# EasyEDA Pro project Archive.eprj, schematic Schematic1
Board Name: CPU; Create Date: 2026-04-07; Page Name: P1; Project Name: Jarvis; Schematic Name: Schematic1; Update Date: 2026-04-08; Company: EasyEDA.com; Page Size: A4; Version: V1.0
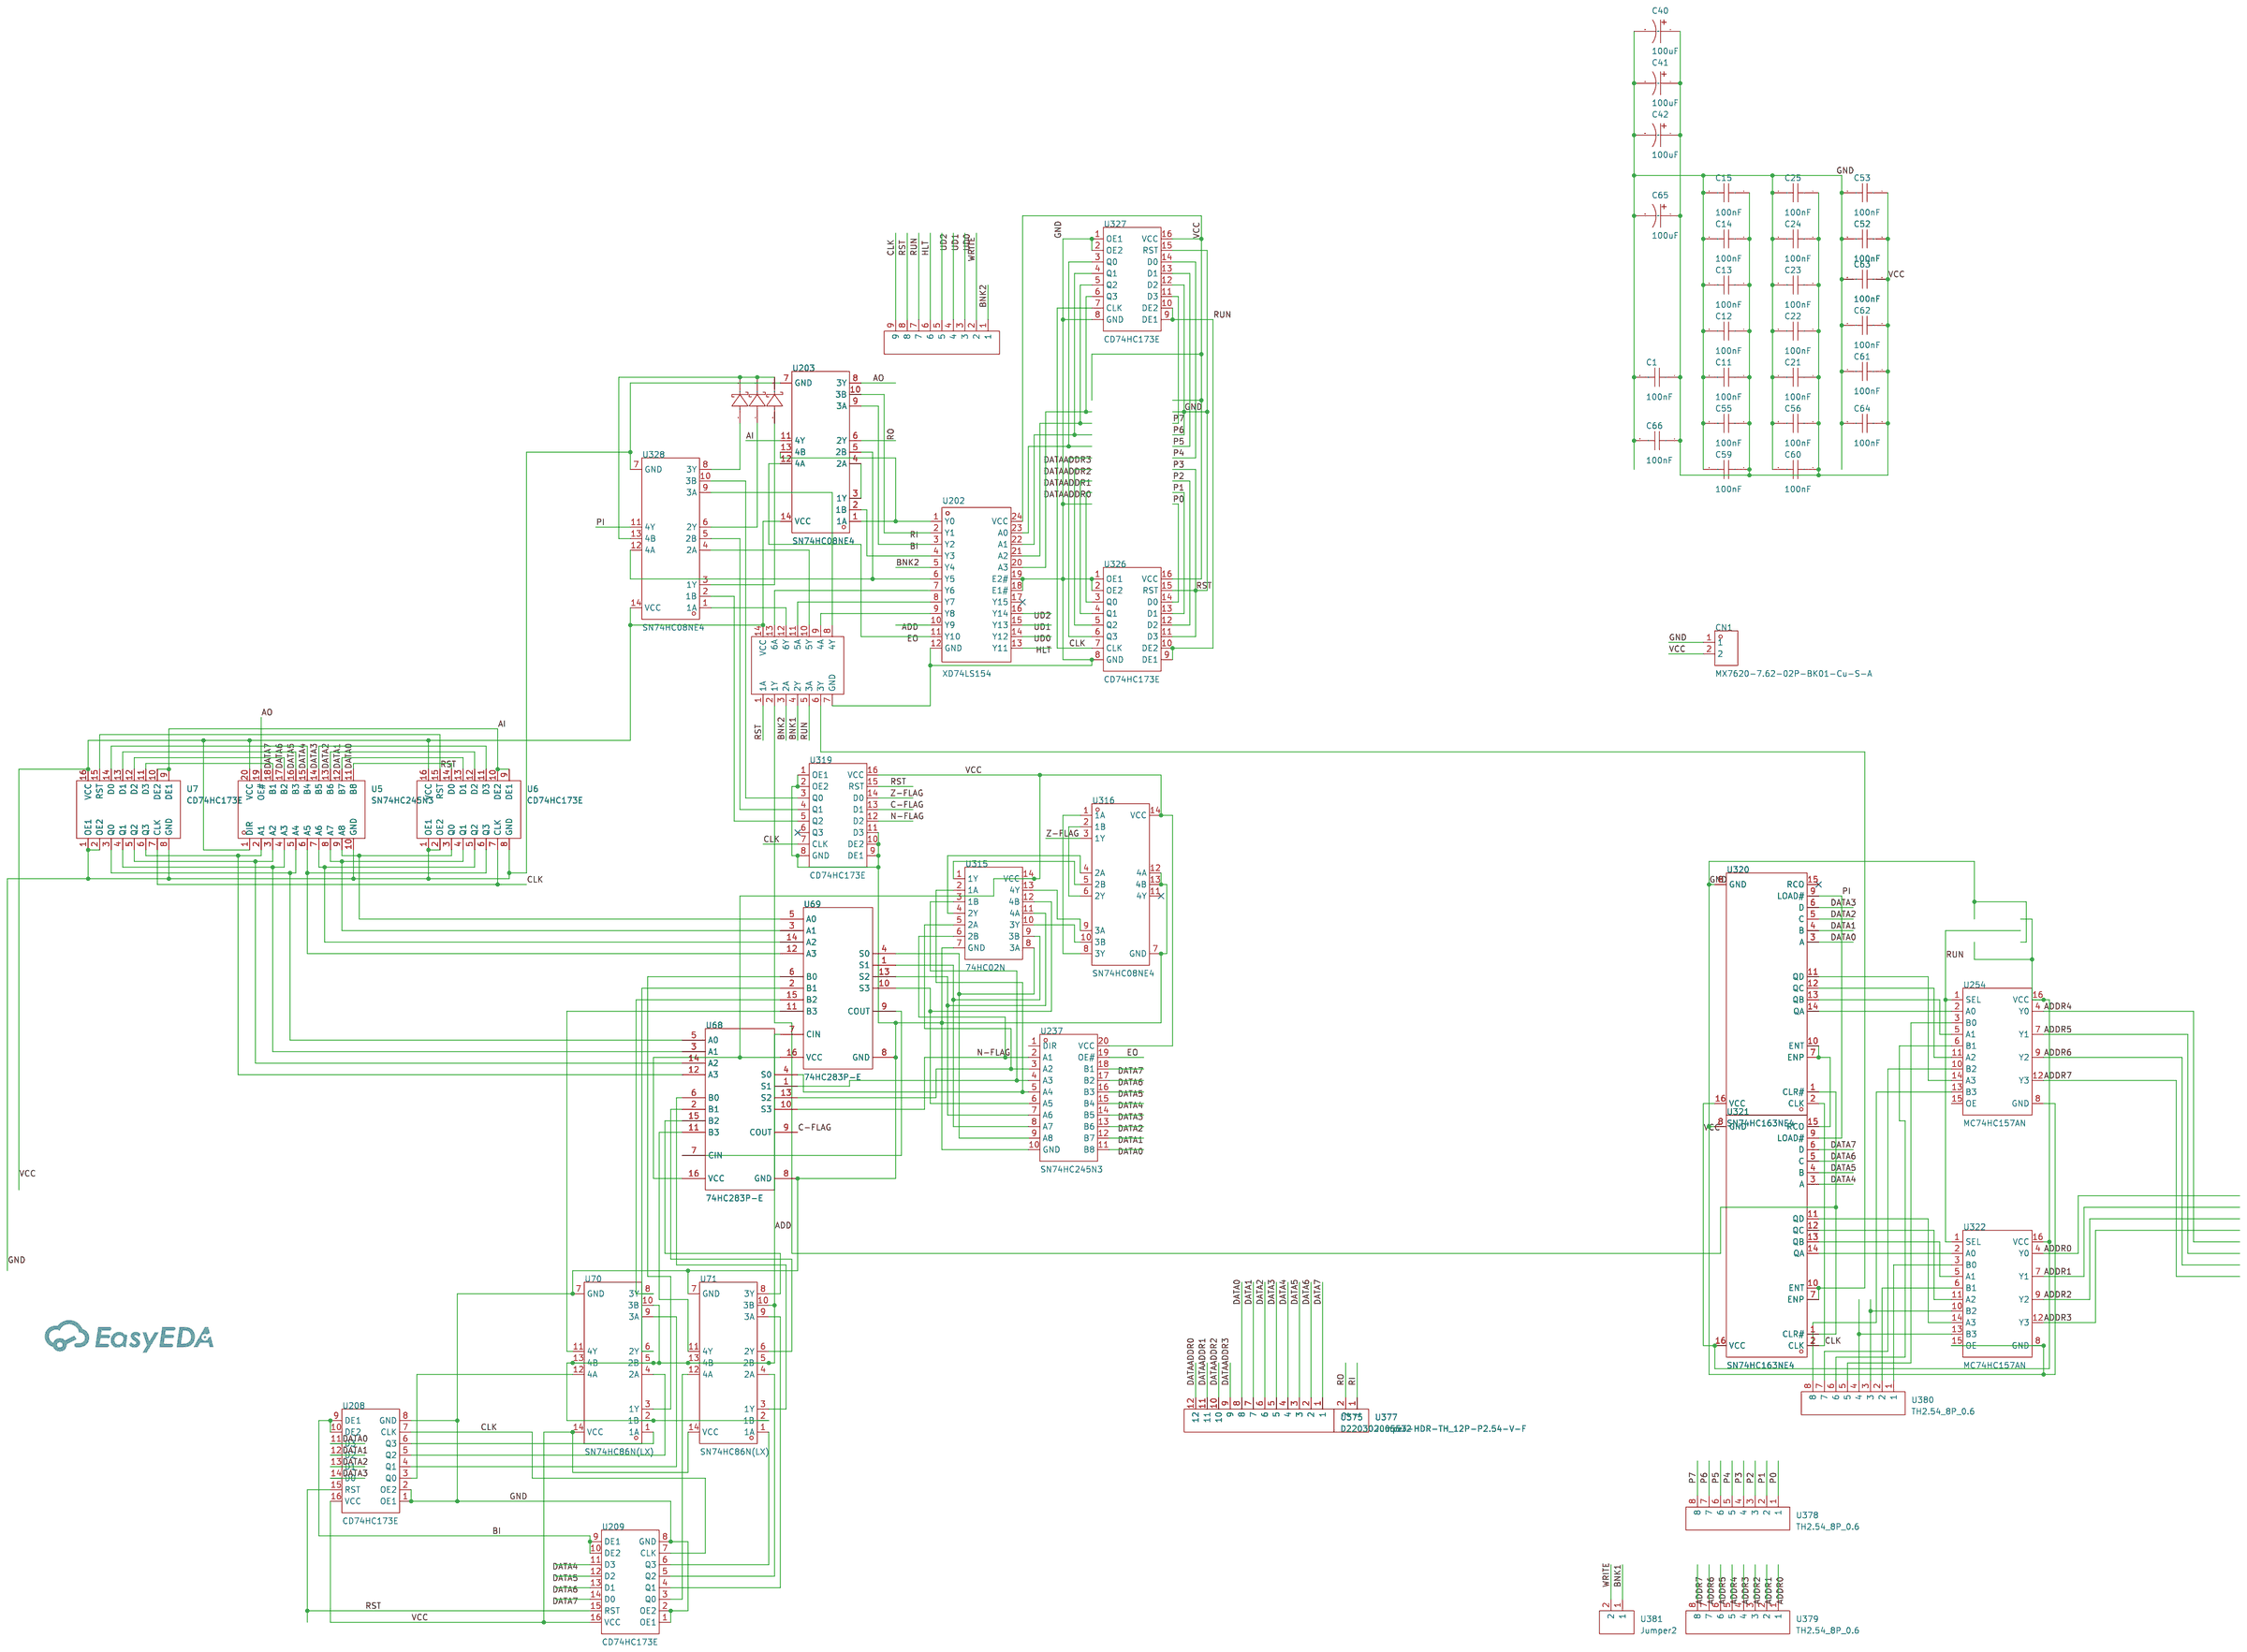
[diagram p1: schematic sheet]

## Parts
C1  100nF  [CAP-TH_L5.0-W2.5-P5.00-D1.0]
C11  100nF  [CAP-TH_L5.0-W2.5-P5.00-D1.0]
C12  100nF  [CAP-TH_L5.0-W2.5-P5.00-D1.0]
C13  100nF  [CAP-TH_L5.0-W2.5-P5.00-D1.0]
C14  100nF  [CAP-TH_L5.0-W2.5-P5.00-D1.0]
C15  100nF  [CAP-TH_L5.0-W2.5-P5.00-D1.0]
C21  100nF  [CAP-TH_L5.0-W2.5-P5.00-D1.0]
C22  100nF  [CAP-TH_L5.0-W2.5-P5.00-D1.0]
C23  100nF  [CAP-TH_L5.0-W2.5-P5.00-D1.0]
C24  100nF  [CAP-TH_L5.0-W2.5-P5.00-D1.0]
C25  100nF  [CAP-TH_L5.0-W2.5-P5.00-D1.0]
C40  100uF  [CAP-TH_BD6.3-P2.50-D1.0-FD]
C41  100uF  [CAP-TH_BD6.3-P2.50-D1.0-FD]
C42  100uF  [CAP-TH_BD6.3-P2.50-D1.0-FD]
C52  100nF  [CAP-TH_L5.0-W2.5-P5.00-D1.0]
C53  100nF  [CAP-TH_L5.0-W2.5-P5.00-D1.0]
C55  100nF  [CAP-TH_L5.0-W2.5-P5.00-D1.0]
C56  100nF  [CAP-TH_L5.0-W2.5-P5.00-D1.0]
C59  100nF  [CAP-TH_L5.0-W2.5-P5.00-D1.0]
C60  100nF  [CAP-TH_L5.0-W2.5-P5.00-D1.0]
C61  100nF  [CAP-TH_L5.0-W2.5-P5.00-D1.0]
C62  100nF  [CAP-TH_L5.0-W2.5-P5.00-D1.0]
C63  100nF  [CAP-TH_L5.0-W2.5-P5.00-D1.0]
C64  100nF  [CAP-TH_L5.0-W2.5-P5.00-D1.0]
C65  100uF  [CAP-TH_BD6.3-P2.50-D1.0-FD]
C66  100nF  [CAP-TH_L5.0-W2.5-P5.00-D1.0]
CN1  MX7620-7.62-02P-BK01-Cu-S-A  [CONN-TH_2P-P7.62_MX7620-7.62-02P-BK01-CU-S-A]
U5  SN74HC245N3  [PDIP-20_L25.9-W6.6-P2.54-LS7.9-BL]
U6  CD74HC173E  [PDIP-16_L19.2-W6.6-P2.54-LS7.6-BL]
U7  CD74HC173E  [PDIP-16_L19.2-W6.6-P2.54-LS7.6-BL]
U68  74HC283P-E  [PDIP-16_L19.3-W6.4-P2.54-LS7.94-BL]
U69  74HC283P-E  [PDIP-16_L19.3-W6.4-P2.54-LS7.94-BL]
U70  SN74HC86N(LX)  [PDIP-14_L19.3-W6.5-P2.54-LS7.6-BL]
U71  SN74HC86N(LX)  [PDIP-14_L19.3-W6.5-P2.54-LS7.6-BL]
U202  XD74LS154  [DIP-24_L31.0-W13.5-P2.54-LS15.2-BL]
U203  SN74HC08NE4  [PDIP-14_L19.3-W6.5-P2.54-LS7.6-BL]
U208  CD74HC173E  [PDIP-16_L19.2-W6.6-P2.54-LS7.6-BL]
U209  CD74HC173E  [PDIP-16_L19.2-W6.6-P2.54-LS7.6-BL]
U210  SN74HC04N(LX)  [DIP-14_L19.6-W6.4-P2.54-LS7.6-BL]
U237  SN74HC245N3  [PDIP-20_L25.9-W6.6-P2.54-LS7.9-BL]
U254  MC74HC157AN  [PDIP-16_L19.3-W6.4-P2.54-LS7.94-BL]
U315  74HC02N  [DIP-14_L19.6-W6.4-P2.54-LS7.6-BL]
U316  SN74HC08NE4  [PDIP-14_L19.3-W6.5-P2.54-LS7.6-BL]
U319  CD74HC173E  [PDIP-16_L19.2-W6.6-P2.54-LS7.6-BL]
U320  SN74HC163NE4  [PDIP-16_L19.3-W6.4-P2.54-LS7.94-BL]
U321  SN74HC163NE4  [PDIP-16_L19.3-W6.4-P2.54-LS7.94-BL]
U322  MC74HC157AN  [PDIP-16_L19.3-W6.4-P2.54-LS7.94-BL]
U326  CD74HC173E  [PDIP-16_L19.2-W6.6-P2.54-LS7.6-BL]
U327  CD74HC173E  [PDIP-16_L19.2-W6.6-P2.54-LS7.6-BL]
U328  SN74HC08NE4  [PDIP-14_L19.3-W6.5-P2.54-LS7.6-BL]
U353  1N4007-DIODE  [DO-41_BD2.4-L4.7-P8.70-D0.8-FD]
U354  1N4007-DIODE  [DO-41_BD2.4-L4.7-P8.70-D0.8-FD]
U355  1N4007-DIODE  [DO-41_BD2.4-L4.7-P8.70-D0.8-FD]
U375  D22030200553-HDR-TH_12P-P2.54-V-F  [HDR-TH_12P-P2.54-V-F]
U377  Jumper2  [HDR-TH_2P-P2.54-V-M-1]
U378  TH2.54_8P_0.6  [HDR-TH_8P-P2.54-V-M-3]
U379  TH2.54_8P_0.6  [HDR-TH_8P-P2.54-V-M-3]
U380  TH2.54_8P_0.6  [HDR-TH_8P-P2.54-V-M-3]
U381  Jumper2  [HDR-TH_2P-P2.54-V-M-1]
U383  HDR2.54-LI-9P  [HDR-TH_9P-P2.54-V-M]

## Library data of the parts
C1 C11-C15 C21-C25 C52 C53 C55 C56 C59-C64 C66 = 178MU0006: Capacitance:100nF Tolerance:±10% Tolerance:±10% Voltage Rating:50V Temperature Coefficient:X7R Pin Spacing:2.54mm; LCSC Part Name: 100nF ±10% 50V; Supplier Part: C5632430; Manufacturer: KNSCHA(科尼盛); Supplier Footprint: 插件,P=2.54mm; JLCPCB Part Class: Extended Part; Datasheet: https://item.szlcsc.com/datasheet/178MU0006/6552585.html; Supplier: LCSC; Tolerance: ±10%; Voltage Rating: 50V; Temperature Coefficient: X7R; Pin Spacing: 2.54mm
C40-C42 C65 = NXA35VB100M6.3*11_LO: Capacitance: Rated Voltage: Lead Spacing: φD: L: Lifetime @ Temp:; LCSC Part Name: 100uF 35V; Supplier Part: C346956; Supplier Footprint: 插件,6.3x11mm; JLCPCB Part Class: Extended Part; Supplier: LCSC
CN1 = MX7620-7.62-02P-BK01-Cu-S-A: Barrier Type:2-Side Pitch:7.62mm Number of Positions or Pins:1x2P Mounting Type:Straight Pin Location:Side Mount Number of Pins:2P Number of Rows:1 Number of PINs Per Row:2 Screw Specification:M3 Current Rating:20A Voltage Rating (Max):300V Wire Gauge - A; LCSC Part Name: 7.62mm 1x2P 直插 边脚 排数:1 每排P数:2; Supplier Part: C5188500; Manufacturer: MAX(迈旭); Supplier Footprint: 插件,P=7.62mm; JLCPCB Part Class: Extended Part; Datasheet: https://item.szlcsc.com/datasheet/MX7620-7.62-02P-BK01-Cu-S-A/5862584.html; Supplier: LCSC; Barrier Type: 2-Side; Pitch: 7.62mm; Number of Positions or Pins: 1x2P; Mounting Type: Straight; Pin Location: Side Mount; Number of Pins: 2P; Number of Rows: 1; Number of PINs Per Row: 2; Screw Specification: M3; Current Rating: 20A; Voltage Rating (Max): 300V; Wire Gauge - AWG: 12~22; Wire Gauge - mm2: 2.5; Operating Temperature: -40℃~+105℃; Color: Black
U5 U237 = SN74HC245N3: Input type:- output type:Tri-State Voltage - Supply:2V~6V Voltage - Supply:2V~6V Number of Elements:1 Number of Bits per Element:8 Channel Type:Bidirectional Current - Output Low(IOL):7.8mA Current - Output High(IOH):7.8mA Logic Family:74HC Operating Temp; Supplier Part: C3587488; Manufacturer: TI(德州仪器); Supplier Footprint: PDIP-20; JLCPCB Part Class: Extended Part; Datasheet: https://item.szlcsc.com/datasheet/SN74HC245N3/4154202.html; Supplier: LCSC; output type: Tri-State; Voltage - Supply: 2V~6V; Number of Elements: 1; Number of Bits per Element: 8; Channel Type: Bidirectional; Current - Output Low(IOL): 7.8mA; Current - Output High(IOH): 7.8mA; Logic Family: 74HC; Operating Temperature: -40℃~+85℃; Quiescent Current: 80uA; Propagation Delay: 21ns@4.5V,50pF
U6 U7 U208 U209 U319 U326 U327 = CD74HC173E: Type:D-Type Trigger Type:Rising Edge Voltage - Supply:2V~6V Voltage - Supply:2V~6V Clock Frequency:60MHz Function:Reset Number of Elements:1 Number of Bits per Element:4 Output Type:Tri-State Propagation Delay:34ns@6V,50pF Series:74HC Series Current - Out; LCSC Part Name: 三态高速CMOS逻辑四路D型触发器; Supplier Part: C1549968; Manufacturer: TI(德州仪器); Supplier Footprint: PDIP-16; JLCPCB Part Class: Extended Part; Datasheet: https://www.ti.com/cn/lit/gpn/cd74hct173; Supplier: LCSC; Type: D-Type; Trigger Type: Rising Edge; Voltage - Supply: 2V~6V; Clock Frequency: 60MHz; Function: Reset; Number of Elements: 1; Number of Bits per Element: 4; Output Type: Tri-State; Propagation Delay: 34ns@6V,50pF; Series: 74HC Series; Current - Output Low(IOL): 7.8mA; Current - Output High(IOH): 7.8mA; Quiescent Current: 8uA; Input Capacitance: 10pF; Operating Temperature: -55℃~+125℃; Setup Time: 12ns; Hold Time: 3ns
U68 U69 = 74HC283P-E: Supplier Part: C17688236; Manufacturer: RENESAS(瑞萨)/IDT; Datasheet: https://item.szlcsc.com/datasheet/74HC283P-E/18817510.html; Supplier: LCSC
U70 U71 = SN74HC86N(LX): Logic Type:XOR Gate Number of Channels:4 Voltage - Supply:2V~6V Voltage - Supply:2V~6V Quiescent Current:2uA Input Logic Level - High:1.5V~4.2V Input Logic Level - High:1.5V~4.2V Input Logic Level - Low:500mV~1.8V Input Logic Level - Low:500mV~1.8V Series; LCSC Part Name: 集成电路; Supplier Part: C22436661; Manufacturer: LX(灵星芯微); Supplier Footprint: DIP-14; JLCPCB Part Class: Extended Part; Datasheet: https://atta.szlcsc.com/upload/public/pdf/source/20240524/675B1C928075FFB7AC00BEC82378813F.pdf; Supplier: LCSC; Logic Type: XOR Gate; Number of Channels: 4; Voltage - Supply: 2V~6V; Quiescent Current: 2uA; Input Logic Level - High: 1.5V~4.2V; Input Logic Level - Low: 500mV~1.8V; Series: 74HCSeries; Operating Temperature: -40℃~+125℃
U202 = XD74LS154: Type:Decoder Voltage Supply Source:Single Supply Voltage - Supply:4.75V~5.25V Voltage - Supply:4.75V~5.25V Number of lines:4/16 Number of lines:4/16 Current - Output Low(IOL):8mA Current - Output High(IOH):400uA Operating temperature:0℃~+70℃ Operating tem; LCSC Part Name: 编码器,解码器,复用器和解复用器; Supplier Part: C707077; Manufacturer: XINLUDA(信路达); Supplier Footprint: DIP-24; JLCPCB Part Class: Extended Part; Datasheet: https://item.szlcsc.com/datasheet/XD74LS154/744199.html; Supplier: LCSC; Type: Decoder; Voltage - Supply: 4.75V~5.25V; Number of lines: 4/16; Current - Output Low(IOL): 8mA; Current - Output High(IOH): 400uA; Operating temperature: 0℃~+70℃; Propagation Delay: 23ns；19ns; Quiescent Current: 9mA
U203 U316 U328 = SN74HC08NE4: Logic Type:AND Gate Number of Channels:4 Voltage - Supply:2V~6V Voltage - Supply:2V~6V Quiescent Current:20uA Current - Output Low(IOL):5.2mA Current - Output High(IOH):5.2mA Input Logic Level - High:1.5V；4.2V；3.15V Input Logic Level - High:1.5V；4.2V；3.15; Supplier Part: C20345708; Manufacturer: TI(德州仪器); Supplier Footprint: PDIP-14; JLCPCB Part Class: Extended Part; Datasheet: https://item.szlcsc.com/datasheet/SN74HC08NE4/21671235.html; Supplier: LCSC; Logic Type: AND Gate; Number of Channels: 4; Voltage - Supply: 2V~6V; Quiescent Current: 20uA; Current - Output Low(IOL): 5.2mA; Current - Output High(IOH): 5.2mA; Input Logic Level - High: 1.5V；4.2V；3.15V; Input Logic Level - Low: 1.35V；500mV；1.8V; Output Logic Level - High: 4.4V；5.9V；1.9V; Output Logic Level - Low: 330mV；260mV；100mV; Series: 74HC; Propagation Delay: 25ns@4.5V,50pF; Operating Temperature: -40℃~+85℃; Input Number: 2
U210 = SN74HC04N(LX): Input Type:- Voltage - Supply:2V~6V Voltage - Supply:2V~6V Quiescent Current(Iq):2uA Number of Circuits:6 Number of Inputs:- Current - Output Low(IOL):- Current - Output High(IOH):- Input Logic Level - High:1.5V~4.2V Input Logic Level - High:1.5V~4.2V Inp; LCSC Part Name: 集成电路; Supplier Part: C22436641; Manufacturer: LX(灵星芯微); Supplier Footprint: DIP-14; JLCPCB Part Class: Extended Part; Datasheet: https://item.szlcsc.com/datasheet/SN74HC04N(LX)/24070577.html; Supplier: LCSC; Voltage - Supply: 2V~6V; Quiescent Current(Iq): 2uA; Number of Circuits: 6; Input Logic Level - High: 1.5V~4.2V; Input Logic Level -Low: 500mV~1.8V; Output Logic Level - High: 4.4V；5.9V；1.9V; Output Logic Level - Low: 260mV；260mV；100mV; Propagation Delay: 14ns@6V,50pF; Series: 74HC Series; Operating Temperature: -40℃~+125℃
U254 U322 = MC74HC157AN: Type:Data Selector/Multiplexers Voltage Supply Source:Single supply Supply Voltage:2V~6V Supply Voltage:2V~6V Sink Current:7.8mA Source Current:7.8mA Operating temperature:-55℃~+125℃ Operating temperature:-55℃~+125℃; Supplier Part: C3231585; Manufacturer: onsemi(安森美); Supplier Footprint: PDIP-16; Datasheet: https://atta.szlcsc.com/upload/public/pdf/source/20230915/AA5F4BE3BD1C30F26D22E0E41BE72F14.pdf; Supplier: LCSC; Type: Data Selector/Multiplexers; Voltage Supply Source: Single supply; Supply Voltage: 2V~6V; Sink Current: 7.8mA; Source Current: 7.8mA; Operating temperature: -55℃~+125℃
U315 = 74HC02N: Logic Type:NOR Gate Number of Channels:4 Voltage - Supply:2V~6V Voltage - Supply:2V~6V Quiescent Current:40uA Current - Output Low(IOL):25mA Current - Output High(IOH):25mA Input Logic Level - High:2.1V~4.2V Input Logic Level - High:2.1V~4.2V Input Logic; LCSC Part Name: 四路 2 输入 或非门; Supplier Part: C507193; Manufacturer: HGSEMI(华冠); Supplier Footprint: DIP-14; JLCPCB Part Class: Extended Part; Datasheet: https://item.szlcsc.com/datasheet/74HC02N/520631.html; Supplier: LCSC; Logic Type: NOR Gate; Number of Channels: 4; Voltage - Supply: 2V~6V; Quiescent Current: 40uA; Current - Output Low(IOL): 25mA; Current - Output High(IOH): 25mA; Input Logic Level - High: 2.1V~4.2V; Input Logic Level - Low: 900mV~1.8V; Output Logic Level - High: 4.4V~5.9V; Output Logic Level - Low: 100mV; Series: 74HC Series; Propagation Delay: 13ns@4.5V,50pF; Operating Temperature: -40℃~+85℃; Input Number: 2
U320 U321 = SN74HC163NE4: Supplier Part: C20345717; Manufacturer: TI(德州仪器); Supplier Footprint: PDIP-16; JLCPCB Part Class: Extended Part; Datasheet: https://atta.szlcsc.com/upload/public/pdf/source/20240116/FC6F7C80FC5EB51F2BFA3EE0E58B1708.pdf; Supplier: LCSC
U353-U355 = 1N4007-DIODE: Supplier Part: C9900005663; Supplier Footprint: DO-41; JLCPCB Part Class: Extended Part; Supplier: LCSC
U375 = D22030200553-HDR-TH_12P-P2.54-V-F: Supplier Part: C9900009321; JLCPCB Part Class: Extended Part; Supplier: LCSC
U377 U381 = Jumper2: Supplier Part: C2940092; Supplier Footprint: HDR-TH-2P-2.54mm; JLCPCB Part Class: Extended Part; Supplier: LCSC
U378-U380 = TH2.54_8P_0.6: Supplier Part: C9900018349; Supplier Footprint: HDR-TH-8P; JLCPCB Part Class: Extended Part; Supplier: LCSC
U383 = HDR2.54-LI-9P: Supplier Part: C9900020142; JLCPCB Part Class: Extended Part; Supplier: LCSC

## Nets
GND: C1.2 C11.2 C12.2 C13.2 C14.2 C15.2 C21.2 C22.2 C23.2 C24.2 C25.2 C40.2 C41.2 C42.2 C52.2 C53.2 C55.2 C56.2 C59.2 C60.2 C61.2 C62.2 C63.2 C64.2 C65.2 C66.2 CN1.1 U5.10(GND) U6.1(OE1) U6.2(OE2) U6.8(GND) U7.1(OE1) U7.2(OE2) U7.8(GND) U68.8(GND) U69.8(GND) U70.7(GND) U71.7(GND) U202.12(GND) U202.18(E1#) U202.19(E2#) U203.7(GND) U208.1(OE1) U208.2(OE2) U208.8(GND) U209.1(OE1) U209.2(OE2) U209.8(GND) U210.7(GND) U237.10(GND) U254.8(GND) U315.7(GND) U316.7(GND) U316.12(4A) U316.13(4B) U319.1(OE1) U319.2(OE2) U319.8(GND) U319.9(DE1) U319.10(DE2) U319.11(D3) U320.8(GND) U321.8(GND) U322.8(GND) U322.15(OE) U326.1(OE1) U326.2(OE2) U326.8(GND) U327.1(OE1) U327.2(OE2) U327.8(GND) U328.7(GND)
VCC: C1.1 C11.1 C12.1 C13.1 C14.1 C15.1 C21.1 C22.1 C23.1 C24.1 C25.1 C40.1 C41.1 C42.1 C52.1 C53.1 C55.1 C56.1 C59.1 C60.1 C61.1 C62.1 C63.1 C64.1 C65.1 C66.1 CN1.2 U5.1(DIR) U5.20(VCC) U6.16(VCC) U7.16(VCC) U68.16(VCC) U69.16(VCC) U70.14(VCC) U71.14(VCC) U202.24(VCC) U203.14(VCC) U208.16(VCC) U209.16(VCC) U210.14(VCC) U237.20(VCC) U254.16(VCC) U315.14(VCC) U316.14(VCC) U319.16(VCC) U320.16(VCC) U321.16(VCC) U322.16(VCC) U326.16(VCC) U327.16(VCC) U328.14(VCC)
ADD: U69.7(CIN) U70.2(1B) U70.5(2B) U70.10(3B) U70.13(4B) U71.2(1B) U71.5(2B) U71.10(3B) U71.13(4B) U202.10(Y9)
ADDR0: U322.4(Y0) U379.1
ADDR1: U322.7(Y1) U379.2
ADDR2: U322.9(Y2) U379.3
ADDR3: U322.12(Y3) U379.4
ADDR4: U254.4(Y0) U379.5
ADDR5: U254.7(Y1) U379.6
ADDR6: U254.9(Y2) U379.7
ADDR7: U254.12(Y3) U379.8
AI: U6.9(DE1) U6.10(DE2) U7.9(DE1) U7.10(DE2) U203.11(4Y)
AO: U5.19(OE#) U203.8(3Y)
BI: U202.3(Y2) U203.9(3A) U208.9(DE1) U208.10(DE2) U209.9(DE1) U209.10(DE2)
BNK1: U210.4(2Y) U381.1
BNK2: U202.5(Y4) U210.3(2A) U383.1
C-FLAG: U68.9(COUT) U319.13(D1)
CLK: U6.7(CLK) U7.7(CLK) U208.7(CLK) U209.7(CLK) U319.7(CLK) U320.2(CLK) U321.2(CLK) U326.7(CLK) U327.7(CLK) U383.9
DATA0: U5.11(B8) U6.14(D0) U208.11(D3) U237.11(B8) U320.3(A) U375.8
DATA1: U5.12(B7) U6.13(D1) U208.12(D2) U237.12(B7) U320.4(B) U375.7
DATA2: U5.13(B6) U6.12(D2) U208.13(D1) U237.13(B6) U320.5(C) U375.6
DATA3: U5.14(B5) U6.11(D3) U208.14(D0) U237.14(B5) U320.6(D) U375.5
DATA4: U5.15(B4) U7.14(D0) U209.11(D3) U237.15(B4) U321.3(A) U375.4
DATA5: U5.16(B3) U7.13(D1) U209.12(D2) U237.16(B3) U321.4(B) U375.3
DATA6: U5.17(B2) U7.12(D2) U209.13(D1) U237.17(B2) U321.5(C) U375.2
DATA7: U5.18(B1) U7.11(D3) U209.14(D0) U237.18(B1) U321.6(D) U375.1
DATAADDR0: U326.3(Q0) U375.12
DATAADDR1: U326.4(Q1) U375.11
DATAADDR2: U326.5(Q2) U375.10
DATAADDR3: U326.6(Q3) U375.9
EO: U202.11(Y10) U203.12(4A) U237.19(OE#)
HLT: U202.13(Y11) U383.6
N-FLAG: U68.10(S3) U237.2(A1) U315.6(2B) U319.12(D2)
P0: U326.14(D0) U378.1
P1: U326.13(D1) U378.2
P2: U326.12(D2) U378.3
P3: U326.11(D3) U378.4
P4: U327.14(D0) U378.5
P5: U327.13(D1) U378.6
P6: U327.12(D2) U378.7
P7: U327.11(D3) U378.8
PI: U320.9(LOAD#) U321.9(LOAD#) U328.11(4Y)
RI: U202.2(Y1) U203.10(3B) U377.1
RO: U203.6(2Y) U377.2
RST: U6.15(RST) U7.15(RST) U208.15(RST) U209.15(RST) U210.1(1A) U319.15(RST) U326.15(RST) U327.15(RST) U383.8
RUN: U210.5(3A) U254.1(SEL) U322.1(SEL) U326.9(DE1) U326.10(DE2) U327.9(DE1) U327.10(DE2) U383.7
UD0: U202.14(Y12) U383.3
UD1: U202.15(Y13) U383.4
UD2: U202.16(Y14) U383.5
WRITE: U381.2 U383.2
Z-FLAG: U316.3(1Y) U319.14(D0)
$1N6877: U315.10(3Y) U316.10(3B)
$1N6878: U315.13(4Y) U316.9(3A)
$1N6879: U315.1(1Y) U316.5(2B)
$1N6880: U316.2(1B) U316.6(2Y)
$1N6881: U315.4(2Y) U316.4(2A)
$1N6882: U316.1(1A) U316.8(3Y)
$1N6912: U68.7(CIN) U69.9(COUT)
$1N6916: U68.2(B1) U71.6(2Y)
$1N6919: U68.15(B2) U71.8(3Y)
$1N6945: U69.6(B0) U70.3(1Y)
$1N6954: U68.6(B0) U71.3(1Y)
$1N6964: U5.2(A1) U7.6(Q3) U68.12(A3)
$1N6965: U5.3(A2) U7.5(Q2) U68.14(A2)
$1N6966: U5.4(A3) U7.4(Q1) U68.3(A1)
$1N6969: U68.11(B3) U71.11(4Y)
$1N6970: U5.8(A7) U6.4(Q1) U69.3(A1)
$1N6971: U5.7(A6) U6.5(Q2) U69.14(A2)
$1N6972: U5.6(A5) U6.6(Q3) U69.12(A3)
$1N6973: U5.5(A4) U7.3(Q0) U68.5(A0)
$1N6974: U5.9(A8) U6.3(Q0) U69.5(A0)
$1N6977: U69.15(B2) U70.8(3Y)
$1N6978: U69.2(B1) U70.6(2Y)
$1N6979: U69.11(B3) U70.11(4Y)
$1N10455: U68.13(S2) U237.3(A2) U315.5(2A)
$1N10479: U69.4(S0) U237.9(A8) U315.8(3A)
$1N10492: U69.1(S1) U237.8(A7) U315.9(3B)
$1N10505: U69.13(S2) U237.7(A6) U315.11(4A)
$1N10556: U68.1(S1) U237.4(A3) U315.3(1B)
$1N10561: U68.4(S0) U237.5(A4) U315.2(1A)
$1N10911: U69.10(S3) U237.6(A5) U315.12(4B)
$1N18479: U254.2(A0) U320.14(QA)
$1N18564: U254.5(A1) U320.13(QB)
$1N18570: U254.11(A2) U320.12(QC)
$1N18580: U254.14(A3) U320.11(QD)
$1N18740: U321.11(QD) U322.14(A3)
$1N18744: U321.13(QB) U322.5(A1)
$1N18748: U321.12(QC) U322.11(A2)
$1N18752: U321.14(QA) U322.2(A0)
$1N19013: U322.3(B0) U380.1
$1N19018: U322.6(B1) U380.2
$1N19027: U322.10(B2) U380.3
$1N19033: U322.13(B3) U380.4
$1N19118: U254.3(B0) U380.5
$1N19124: U254.6(B1) U380.6
$1N19130: U254.10(B2) U380.7
$1N19136: U254.13(B3) U380.8
$1N19903: U202.20(A3) U327.6(Q3)
$1N19904: U202.21(A2) U327.5(Q2)
$1N19905: U202.22(A1) U327.4(Q1)
$1N19906: U202.23(A0) U327.3(Q0)
$1N20210: U202.1(Y0) U203.1(1A) U203.13(4B)
$1N20313: U203.3(1Y) U203.4(2A)
$1N20334: U202.4(Y3) U203.2(1B)
$1N20604: U202.7(Y6) U210.13(6A)
$1N20609: U202.8(Y7) U210.11(5A)
$1N20615: U202.9(Y8) U210.9(4A)
$1N20624: U210.12(6Y) U328.1(1A)
$1N20629: U210.10(5Y) U328.4(2A)
$1N20635: U210.8(4Y) U328.9(3A)
$1N20738: U328.3(1Y) U353.1(A)
$1N20743: U328.6(2Y) U354.1(A)
$1N20749: U328.8(3Y) U355.1(A)
$1N20922: U319.3(Q0) U328.10(3B)
$1N20931: U319.4(Q1) U328.5(2B)
$1N20939: U319.5(Q2) U328.2(1B)
$1N21979: U328.13(4B) U353.2(K) U354.2(K) U355.2(K)
$1N21984: U202.6(Y5) U203.5(2B) U328.12(4A)
$1N29886: U320.7(ENP) U320.10(ENT) U321.15(RCO)
$1N29905: U210.6(3Y) U321.7(ENP) U321.10(ENT)
$1N30006: U210.2(1Y) U320.1(CLR#) U321.1(CLR#)
$1N35185: U70.1(1A) U208.6(Q3)
$1N35190: U70.4(2A) U208.5(Q2)
$1N35200: U70.9(3A) U208.4(Q1)
$1N35210: U70.12(4A) U208.3(Q0)
$1N35217: U71.1(1A) U209.6(Q3)
$1N35223: U71.4(2A) U209.5(Q2)
$1N35233: U71.9(3A) U209.4(Q1)
$1N35243: U71.12(4A) U209.3(Q0)

Not connected (* = marked no-connect by the designer): U202 17(Y15)*; U237 1(DIR); U254 15(OE); U316 11(4Y)*; U319 6(Q3)*; U320 15(RCO)*
